# EasyEDA Pro project BlueberryPi.eprj, board PCB1 (continued)
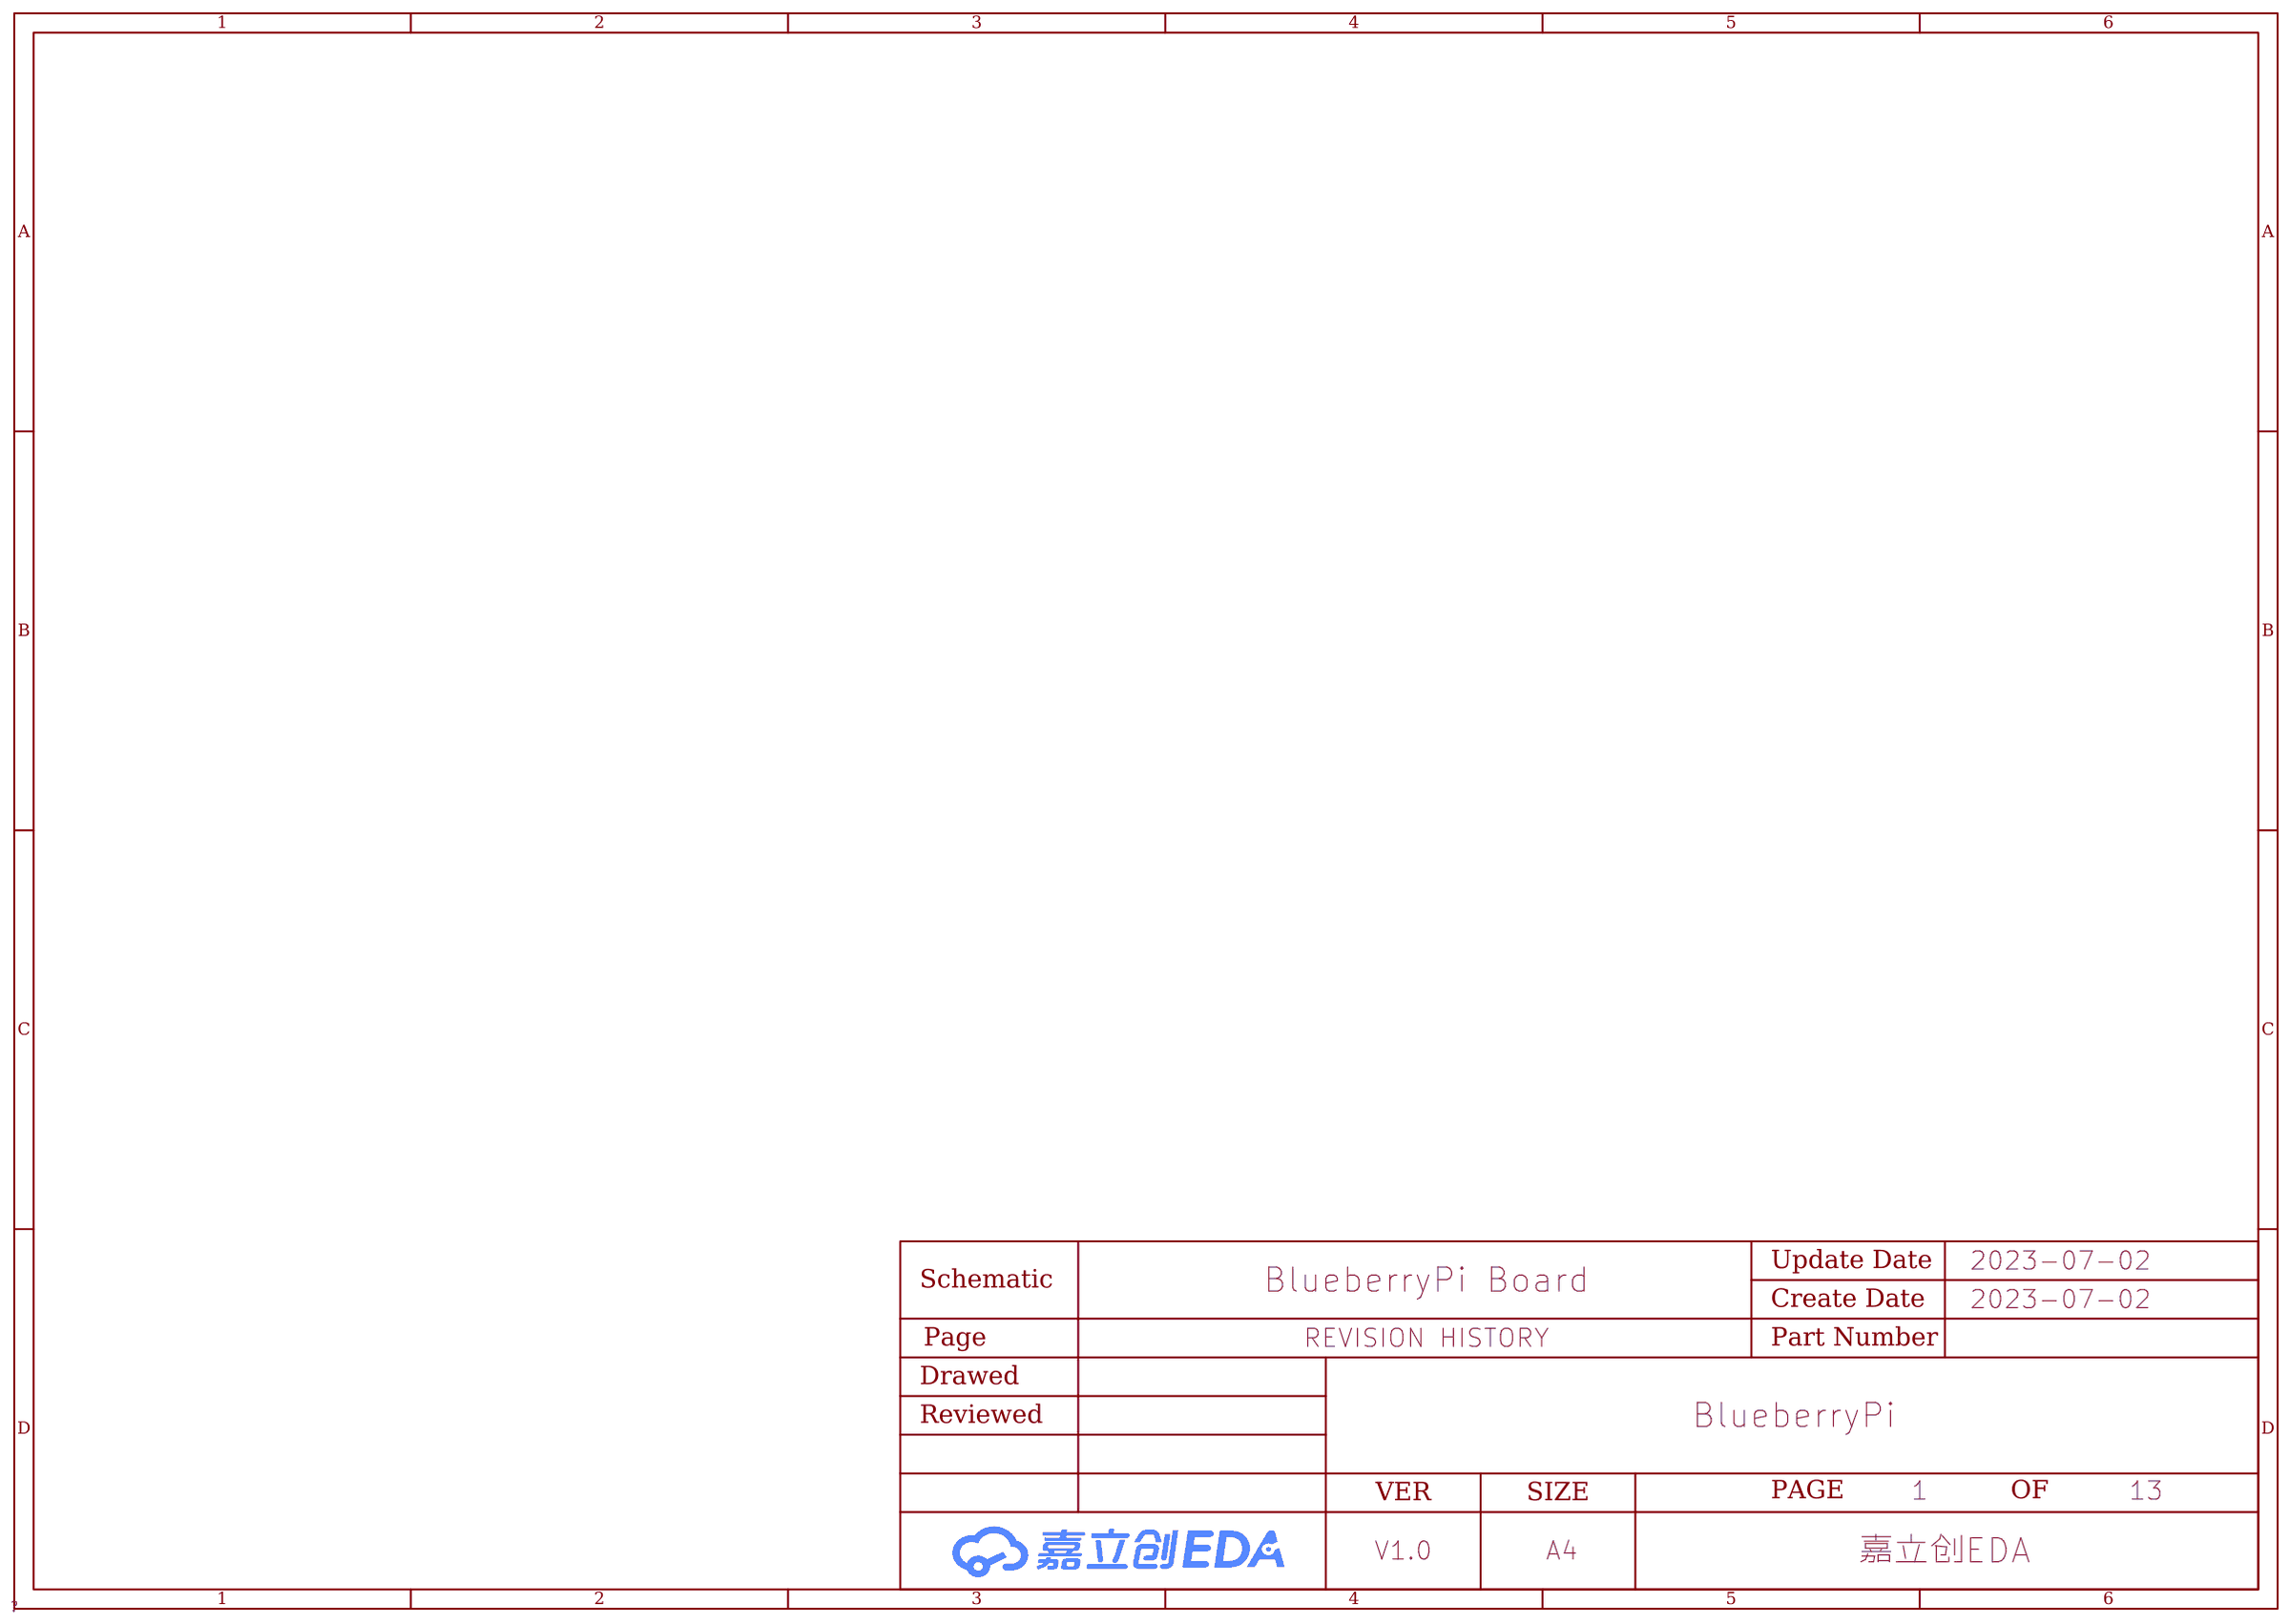
[diagram p0: REVISION HISTORY]
## Footprints (pads in the part's own frame, mm; a bottom-side part is the same pattern mirrored in y, then rotated) (continued)
USB-A-TH_XUNPU_USB-303WSD-BRY
  round 1.1 hole 0.7: 1(-3.5,-1.35) 2(-1,-1.35) 3(1,-1.35) 4(3.5,-1.35) 5(4,0.15) 6(2,0.15) 7(0,0.15) 8(-2,0.15) 9(-4,0.15) 10(-3.5,1.85) 11(-1,1.85) 12(1,1.85) 13(3.5,1.85) 14(4,3.35) 15(2,3.35) 16(0,3.35) 17(-2,3.35) 18(-4,3.35)
  round 3.2 hole 2.4: 19(6.57,-3.35) 20(6.57,2.33) 21(-6.57,2.33) 22(-6.57,-3.35)

## Nets
As in the schematic.

Pads without a net: CN1 14; U1 A3 A5 A6 A8 A9 A10 AA3 AA10 B1 B2 B5 B6 B7 B8 B9 B10 C1 C2 C5 C23 D15 D16 E17 E21 E22 F5 F11 G10 H17 H19 H20 J19 L2 L6 M2 M3 M4 M5 M6 N2 N3 P1 P2 P3 P5 P6 P21 P22 R21 T1 T2 T20 U4 V2 V3 V21 V22 V23 W4 W11 Y21; U35 A1 A2 A12 A13 B1 B4 B13 C4 K9 R3 T1 T13 U1 U2 U12 U13; U37 5 14 21 22 55 56; U39 A1 A2 A7 A8 A9 A10 A11 A12 A13 A14 B1 B7 B8 B9 B10 B11 B12 B13 B14 C1 C3 C5 C7 C8 C9 C10 C11 C12 C13 C14 D1 D2 D3 D4 D12 D13 D14 E1 E2 E3 E5 E8 E9 E10 E12 E13 E14 F1 F2 F3 F10 F12 F13 F14 G1 G2 G3 G10 G12 G13 G14 H1 H2 H3 H12 H13 H14 J1 J2 J3 J12 J13 J14 K1 K2 K3 K6 K7 K10 K12 K13 K14 L1 L2 L3 L12 L13 L14 M1 M2 M3 M7 M8 M9 M10 M11 M12 M13 M14 N1 N3 N6 N7 N8 N9 N10 N11 N12 N13 N14 P1 P2 P7 P8 P9 P10 P11 P12 P13 P14; U64 4 5 8 29 30 32 35 37 38 39 40 45 46 47; U66 4; USB1 2 3 4; USB3 5 6 8 9

## Via types
v1: diameter 5.08, hole 4.064, Top Layer to Bottom Layer, 4 vias
v2: diameter 0.399, hole 0.299, Top Layer to Bottom Layer, 809 vias
v3: diameter 0.4, hole 0.3, Top Layer to Bottom Layer, 21 vias

## Routing (per net, layer and track width the routed paths; a pad name or vN(x,y) marks a point on that pad's centre or on a via; arc(x,y) is an arc through that point)
GND: length 429
  Top Layer w0.127: U1.W1 42.71,45.31 43.35,45.31 U1.W3 ; v2(69.87,49.28) 69.59,49 69.59,48.5 U39.C4 ; U1.E1 42.01,54.08 v2(41.85,54.24) ; 45.61,43.45 45.34,43.18 45.34,42.87 44.98,42.52 U1.AC5 ; U39.N5 73.87,48.39 74.26,48.78 v2(74.37,48.78) ; v2(23.29,22.5) 22.71,23.09 R75.1 ; 55.61,58.14 55.3,57.82 55.3,56.76 U1.A21 ; 45.61,44.33 45.61,44.33 ; U1.AC11 48.88,41.23 v2(49,41.11)
  Top Layer w0.152: U35.T12 54.08,32.18 54.41,32.51 54.41,32.97 v2(54.15,33.22)
  Top Layer w0.203: U37.8 14.68,54.28 ; U37.54 12.68,55.2 U37.57 ; U37.11 15.88,54.28
  Top Layer w0.254: v2(53.77,42.67) 53.79,42.67 U1.AC19 ; v2(51.48,26.34) U35.M4 U35.N4 ; v2(51.48,26.34) v2(51.48,27.14) ; v2(51.48,26.34) v2(52.13,26.34) ; U1.M1 41.9,49.05 v2(38.93,49.05) ; U1.AB21 v2(55.38,43.68) U1.AA20 ; 47.18,32.77 47.92,33.5 47.97,33.5 ; 47.18,32.77 v2(47.18,33.02) ; 47.18,32.77 47,32.59 46.93,32.59 ; 47.18,32.77 v2(47.18,32.58) 47.18,32.34 ; U35.H2 48.88,23.2 v2(48.35,22.67) ; v2(50.18,54.08) U1.C13 ; v2(54.08,26.34) v2(53.43,26.34) ; v2(54.08,26.34) v2(54.08,25.54) ; v2(54.08,26.34) v2(54.08,27.14) U35.R6 v2(53.43,26.34) ; v2(53.43,26.34) v2(53.43,25.54) v2(54.08,25.54) ; v2(43.68,59.08) v2(43.09,59.08) v2(42.46,59.08) v2(41.84,59.08) C49.1 ; v2(51.48,27.14) U35.L6 ; v2(51.48,27.14) v2(52.13,27.14) v2(52.13,26.34) ; v2(46.93,26.34) v2(46.93,25.54) ; v2(46.93,26.34) v2(46.93,27.14) v2(47.58,27.14) ; v2(46.93,26.34) U35.F5 ; v2(46.93,25.54) 46.93,25.39 U35.D3 U35.C3 44.98,24.09 U35.B2 ; v2(46.93,25.54) U35.F4 ; v2(63.5,52.89) 64.29,53.68 64.29,62.73 X2.2 X2.3 60.99,63.35 C40.2 58.65,63.17 56.62,61.14 v2(56.62,59.66) ; v2(54.08,25.54) U35.T3 U35.T2 ; U35.G3 v2(48.23,25.54) U35.F4 ; U1.A23 56.88,56.68 v2(57.1,56.9) ; 47.18,32.34 46.93,32.59 ; 47.18,32.34 U35.F12 ; v2(47.58,27.14) U35.F5 ; v2(47.58,27.14) v2(48.23,27.14) ; U35.F5 U35.F4 ; U1.U23 57.28,46.28 v2(57.3,46.25) ; 46.93,32.59 U35.D12 ; v2(57.51,52.51) 57.12,52.13 U1.H23 ; v2(50.83,29.54) 50.18,30.19 U35.K10 ; U35.M12 52.13,32.59 v2(52.13,32.59) ; v2(14.92,11.96) 15.4,11.49 U66.2 ; v2(60.11,43.98) 59.11,44.98 U1.W23 ; v2(44.98,32.28) 44.98,32.28 U35.B12 ; v2(50.18,43.03) U1.AA14 U1.Y13 49.53,43.68 U1.AA11 ; U1.M23 57.3,49.53 v2(57.46,49.38) ; U1.E18 53,54.51 53,54.95 U1.C18 ; U1.Y5 U1.AA4 U1.AB3 ; 45.61,43.45 45.61,44.33 ; U1.H1 39.24,52.13 C29.1 v2(38.67,52.78) ; 47.97,33.5 47.97,34.34 ; 47.97,33.5 v2(48.98,32.49) U35.J12 ; U35.H10 48.23,29.69 v2(48.23,29.54) ; v2(52.78,44.33) U1.AA16 ; v2(52.13,26.34) U35.N4 ; U35.N4 52.13,25.39 U35.P3 ; v2(41.85,57.07) 42.23,56.68 U1.A1 ; v2(45.63,46.28) v2(44.98,45.63) v2(44.33,45.63) U1.W3 ; v2(52.13,32.59) 52.13,35 C80.1 ; v2(52.13,32.59) U35.P12 ; v2(75.46,47.78) 74.37,47.78 U39.P4 ; U1.C22 U1.D23 57.19,54.73 v2(57.33,54.86) ; U35.K2 v2(50.18,22.67) ; U1.K17 U1.L18 ; U1.A16 52.13,57.26 ; 5.67,30.86 6.37,30.86 6.95,30.28 v2(7.88,30.28) ; U1.AA8 U1.Y7 ; U1.P7 v2(46.93,47.58) ; v2(44.98,27.14) v2(44.98,26.34) v2(45.63,26.34) v2(45.63,27.14) v2(44.98,27.14)
  Top Layer w0.305: U1.H15 U1.H16 U1.J16 ; U1.H15 U1.G15 U1.F15 ; U1.H15 U1.J15 ; v2(48.88,46.93) v2(49.53,46.93) ; v2(48.88,46.93) v2(48.88,46.28) ; v2(48.88,46.93) v2(48.23,46.93) ; v2(48.88,46.93) v2(48.88,47.58) ; v2(49.53,46.93) U1.U12 v2(48.88,46.28) ; v2(49.53,46.93) U1.T13 ; v2(49.53,46.93) v2(49.53,47.58) ; U1.V19 U1.W19 ; U1.V19 v2(53.85,45.86) v2(53.43,46.28) ; U1.V19 U1.V17 ; U1.V19 U1.V20 54.73,45 ; U1.W19 U1.W21 ; U1.W19 U1.W17 ; U1.W19 U1.Y19 v2(52.78,44.33) U1.W17 ; v2(53.43,48.88) v2(53.43,49.53) U1.L18 ; v2(46.93,46.93) v2(46.28,46.93) v2(46.28,46.28) ; v2(46.93,46.93) v2(46.93,47.58) v2(47.58,47.58) ; v2(46.93,46.93) v2(47.58,46.93) ; U1.F15 U1.F14 U1.F13 ; U1.F15 U1.E15 U1.E16 U1.F16 ; U1.F15 U1.F16 ; v2(48.23,50.83) v2(48.88,50.83) ; v2(48.23,50.83) v2(48.23,50.18) ; v2(48.23,50.83) v2(48.23,51.48) ; v2(48.23,50.83) v2(47.58,50.83) ; v2(48.88,50.83) v2(48.88,50.18) ; v2(48.88,50.83) v2(49.53,50.83) ; v2(48.88,50.83) v2(48.88,51.48) ; v2(50.83,50.18) v2(50.83,49.53) ; v2(50.83,50.18) v2(50.18,50.18) ; v2(50.83,50.18) U1.L15 ; v2(50.83,50.18) U1.K14 ; v2(50.83,49.53) v2(50.83,48.88) ; v2(50.83,49.53) U1.M15 ; v2(50.83,49.53) v2(50.18,49.53) ; v2(50.83,47.58) v2(51.48,47.58) v2(51.48,46.93) ; v2(50.83,47.58) v2(50.83,48.23) ; v2(50.83,47.58) v2(50.18,47.58) ; v2(50.83,47.58) U1.T14 ; v2(85.85,28.98) 85.85,26.67 ; v2(49.53,50.83) v2(49.53,50.18) ; v2(49.53,50.83) U1.J12 ; v2(49.53,50.83) U1.K13 ; v2(49.53,50.18) v2(48.88,50.18) ; v2(49.53,50.18) v2(50.18,50.18) ; v2(49.53,50.18) v2(49.53,49.53) ; v2(46.93,50.83) v2(46.93,51.48) ; v2(46.93,50.83) v2(47.58,50.83) ; v2(46.93,50.83) U1.K7 ; v2(46.93,51.48) U1.H8 ; v2(46.93,51.48) v2(47.58,51.48) ; v2(46.93,51.48) U1.J7 ; U1.J16 U1.J15 ; U1.J16 U1.J17 U1.K17 U1.K16 ; U1.J16 U1.K16 ; v2(47.58,50.83) v2(47.58,51.48) ; v2(47.58,50.83) v2(47.58,50.18) v2(48.23,50.18) ; v2(48.88,46.28) v2(48.23,46.28) ; v2(48.88,48.88) v2(48.23,48.88) ; v2(48.88,48.88) v2(48.88,49.53) ; v2(48.88,48.88) v2(48.88,48.23) ; v2(48.88,48.88) v2(49.53,48.88) ; v2(48.23,48.88) v2(48.23,49.53) ; v2(48.23,48.88) v2(48.23,48.23) ; v2(48.88,49.53) v2(48.23,49.53) ; v2(48.88,49.53) v2(49.53,49.53) ; v2(48.88,49.53) v2(48.88,50.18) ; v2(48.23,49.53) v2(48.23,50.18) ; v2(50.18,50.18) v2(50.18,49.53) ; v2(50.18,50.18) U1.K13 ; v2(50.18,49.53) v2(49.53,49.53) ; v2(50.18,49.53) v2(50.18,48.88) ; v2(85.85,20.09) 85.85,17.78 ; U1.W16 U1.W17 ; U1.W17 U1.V17 ; v2(48.23,50.18) v2(48.88,50.18) ; U1.H8 v2(46.28,52.13) ; U1.H8 v2(47.58,52.13) ; v2(52.78,46.28) v2(52.13,46.93) v2(51.48,46.93) ; v2(52.78,46.28) v2(53.43,46.28) ; v2(52.78,46.28) U1.V17 ; v2(49.53,49.53) v2(49.53,48.88) ; v2(47.58,47.58) v2(48.23,47.58) ; v2(47.58,47.58) v2(47.58,46.93) ; v2(48.23,47.58) v2(48.23,46.93) ; v2(48.23,47.58) v2(48.23,48.23) ; v2(48.23,47.58) v2(48.88,47.58) ; v2(75.69,28.98) 75.69,26.67 ; U1.U22 U1.U23 ; v2(48.5,81.09) v2(48.5,79.84) v2(48.5,78.47) v2(48.5,77.15) v2(48.5,75.73) v2(48.5,74.43) v2(48.5,73.12) v2(48.5,71.8) v2(48.5,66.53) v2(48.5,65.16) v2(48.5,63.76) 48.5,59.7 ; U1.T14 v2(51.48,46.93) ; U1.T14 U1.T13 ; v2(51.48,46.93) U1.U15 ; U1.J7 U1.K7 ; U1.J7 v2(46.28,52.13) ; U1.K7 U1.L7 U1.M7 U1.N7 U1.P7 46.28,48.16 ; v2(49.53,48.23) v2(50.18,48.23) ; v2(49.53,48.23) v2(48.88,48.23) ; v2(49.53,48.23) v2(49.53,47.58) ; v2(49.53,48.23) v2(49.53,48.88) ; v2(50.18,48.23) v2(50.18,47.58) ; v2(50.18,48.23) v2(50.83,48.23) ; v2(50.18,48.23) v2(50.18,48.88) ; v2(53.43,46.28) v2(53.43,46.93) ; v2(47.58,51.48) v2(47.58,52.13) ; v2(47.58,51.48) v2(48.23,51.48) ; U1.J15 U1.K15 ; v3(17.72,84) U44.1 v3(15.52,84) ; v2(50.83,48.88) v2(50.18,48.88) ; v2(50.83,48.88) v2(50.83,48.23) ; v2(50.83,48.88) U1.N15 U1.M15 ; U1.K13 U1.K14 ; v2(48.23,46.93) v2(47.58,46.93) ; v2(48.23,46.93) v2(48.23,46.28) ; U1.J12 v2(48.88,51.48) ; U1.J12 U1.H12 ; U1.M15 U1.L15 ; U1.T13 v2(50.18,47.58) ; v2(50.83,55.38) U1.C13 U1.C12 ; v2(47.58,46.93) v2(47.58,46.28) v2(48.23,46.28) ; v2(46.28,52.13) U1.G7 ; v2(48.88,48.23) v2(48.88,47.58) ; v2(48.88,48.23) v2(48.23,48.23) ; U1.K14 U1.K15 ; v2(49.84,63.75) v2(49.84,65.15) v2(49.84,66.51) v2(49.84,67.8) v2(49.84,71.81) v2(49.84,73.11) v2(49.84,74.45) v2(49.84,75.74) v2(49.84,77.15) v2(49.84,78.47) v2(49.84,79.84) D2.3 D2.8 ; U1.AC1 42.25,42.25 v2(42.25,41.95) ; v2(51.26,63.78) v2(51.26,65.15) v2(51.26,66.51) v2(51.26,67.8) v2(51.26,69.06) v2(51.26,73.11) v2(51.26,74.45) v2(51.26,75.72) v2(51.26,77.15) v2(51.26,78.47) v2(51.26,79.84) v2(51.26,81.32) ; U1.F13 U1.F12 ; U1.F13 v2(50.18,54.08) ; v2(50.18,48.88) v2(49.53,48.88) ; U1.W5 U1.Y5 U1.Y7 U1.W7 ; U1.W5 U1.W7 ; U1.W5 v2(44.98,45.63) ; U1.L15 U1.K15 ; v2(47.58,52.13) U1.H10 v2(48.23,51.48) ; v2(47.58,52.13) v2(47.58,52.78) ; v2(48.88,47.58) v2(49.53,47.58) ; v2(49.53,47.58) v2(50.18,47.58) ; U1.W7 U1.V7 v2(46.28,46.28) ; U1.W7 U1.W8 U1.W10 ; U1.R17 U1.R18 v2(53.43,46.93) ; v2(17.11,19.51) 16.26,18.66 v2(16.26,17.93) 16.26,15.55 16.7,15.1 20.4,15.1 20.79,15.49 v2(20.79,16.74) v2(20.79,19.51) ; v2(54.43,63.55) v2(56.72,65.84) v2(59.2,68.32) v2(62.54,71.66) v2(63.83,72.95) v2(65.1,74.22) v2(66.43,75.55) 68.25,77.37 v2(68.25,80.99) v2(68.25,82.79) v2(68.25,84.67) v2(68.25,86.64) v2(68.25,87.5) ; v2(48.23,51.48) v2(48.88,51.48) ; v2(53.43,46.93) U1.T19 ; v2(75.69,20.09) 75.69,17.78 ; U1.K15 U1.K16 ; v2(53.67,65.04) v2(55.64,67.01) v2(58.04,69.41) v2(61.35,72.71) v2(62.67,74.04) v2(63.91,75.28) v2(65.28,76.64) 66.75,78.12 v2(66.75,80.99) v2(66.75,82.79) v2(66.75,84.68) v2(66.75,86.64) v2(66.75,87.5) ; U1.F16 U1.F17 U1.E18 ; v2(69.75,87.5) v2(69.75,86.64) v2(69.75,84.67) v2(69.75,82.79) v2(69.75,81.01) 69.75,76.56 v2(68.94,75.75) v2(67.6,74.41) v2(66.29,73.1) v2(65,71.81) v2(60.38,67.19) v2(57.88,64.69) v2(56.68,63.49) 55.28,62.09 ; v2(45.63,46.28) v2(46.28,46.28)
  Top Layer w0.381: D2.8 49.84,85.6
  Bottom Layer w0.254: v2(71.87,49.3) 71.89,49.3 v2(72.37,49.78) ; C58.1 56.69,46.86 v2(57.3,46.25) ; C81.1 46.93,27.54 v2(46.93,27.14) ; 51.89,27.43 52.13,27.19 v2(52.13,27.14) ; v2(71.37,50.78) 71.01,50.42 v2(71.01,50.3) ; C53.1 56.27,57.19 56.27,58.17 v2(55.73,58.71) ; v2(57.46,49.38) 57.46,49.11 C1.1 ; C14.1 52.12,51.83 C3.1 ; 57.34,53.12 C46.1 ; 57.34,53.12 57.34,52.68 v2(57.51,52.51) ; 57.34,53.12 56.49,53.12 ; C55.1 52.12,54.11 C56.1 ; v2(67.83,44.22) v2(68.87,44.22)
  vias: v2(2.31,15.8) v2(2.46,18.57) v2(2.72,60.69) v2(2.72,54.73) v2(3.77,82.4) v2(3.77,76.1) v2(3.89,18.97) v2(3.89,15.62) v2(4.52,18.2) v2(4.52,16.33) v2(5.41,18.2) v2(5.41,16.33) v2(6.3,18.2) v2(6.3,16.33) v2(6.98,48.5) v2(7.19,18.2) v2(7.19,16.33) v2(7.86,97.05) v2(8.12,18.67) v2(8.05,16.65) v2(8.54,87.34) v2(8.77,75.89) v2(8.93,77.5) v2(8.89,48.53) v2(8.92,19.48) v2(8.88,17.18) v2(9.2,79.38) v2(9.27,33.47) v2(9.27,21.69) v2(9.28,20.46) v2(9.68,17.83) v2(10.38,18.66) v2(10.85,81.69) v2(10.8,48.53) v2(10.82,19.51) v2(11.07,57.39) v2(11.07,21.69) v2(11.08,20.46) v2(11.55,67.21) v2(12.08,60.4) v2(12.14,58.6) v2(12.14,55.8) v2(12.31,54.51) v2(13.58,45.97) v2(13.68,60.4) v2(13.7,54.53) v2(13.77,18.16) v2(14.55,64.23) v2(14.92,6.58) v2(15.2,5.05) v2(15.27,59.54) v2(15.37,17.92) v2(16.28,16.73) v2(16.28,15.26) v2(16.36,64.2) v2(16.66,59.53) v2(16.93,54.55) v2(17.09,57.15) v2(17.09,55.75) v2(17.44,17.92) v2(18.82,86.49) v2(19.64,16.22) v2(19.71,63.99) v2(19.71,36.54) v2(19.66,30.28) v2(20.16,46) v2(20.84,15.25) v2(21.15,5.41) v2(21.56,35.05) v2(22.31,52.04) v2(22.44,60.07) v2(22.44,57.12) v2(22.44,55.37) v2(22.44,53.54) v2(22.53,2.86) v2(22.77,13.31) v2(23.08,11.71) v2(23.22,87.34) v2(23.38,97.05) v2(24.08,2.93) v2(28.97,85.7) v2(29.27,87.27) v2(31.85,87.3) v2(32.91,49.17) v2(34.04,60.56) v2(34.39,52.09) v2(34.39,49.18) v2(34.65,87.3) v2(35.56,60.25) v2(35.88,52.25) v2(36.83,37.25) v2(37.3,29.91) v2(38.48,37.25) v2(39.04,30.06) v2(39.31,64.57) v2(39.47,78.18) v2(39.59,42.39) v2(39.75,37.1) v2(40.64,61.89) v2(40.69,26.05) v2(41.31,81.33) v2(41.75,22.86) v2(43.68,54.08) v2(44.98,54.08) v2(45.52,82.6) v2(45.47,19.32) v2(46.49,21.69) v2(46.71,19.24) v2(47.9,82.6) v2(49.53,25.54) v2(50.18,45.63) v2(50.34,27.95) v2(50.27,21.69) v2(51.77,82.6) v2(52.88,21.69) v2(52.88,20.47) v2(53.14,19.2) v2(53.47,54.08) v2(54.15,82.6) v2(54.41,45.76) v2(54.73,48.29) v2(55.42,78.61) v2(55.38,53.43) v2(56.68,42.38) v2(57.21,81.25) v2(57.28,22.86) v2(58.2,26.05) v2(58.61,59.82) v2(58.59,52.53) v2(59.72,52.42) v2(60.81,58.12) v2(61.29,56.33) v2(66,90.29) v2(66.53,51.3) v2(67.5,90.29) v2(67.87,48.78) v2(69,90.29) v2(69.37,51.17) v2(70.5,90.29) v2(70.54,44.64) v2(70.87,48.28) v2(71.7,86.72) v2(71.87,48.28) v2(72.87,86.72) v2(73.1,29.68) v2(73.5,90.29) v2(73.87,46.78) v2(74.04,86.72) v2(75.21,86.72) v2(75.69,26.67) v2(75.69,17.78) v2(76.38,86.72) v2(78.13,57.16) v2(78.17,60.97) v2(78.92,86.32) v2(82.96,97.14) v2(85.85,26.67) v2(85.85,17.78) v3(13.32,84) v3(14.42,84) v3(19.92,84) v3(21.02,84) v3(22.12,84)
VCC18-RTC: length 69.5
  Top Layer w0.203: R38.1 21.04,53.54
  Top Layer w0.254: C54.2 61.77,51.59 v2(61.77,53.12) ; R26.1 27.53,52.57 27.53,55.58 27.8,55.84 28.27,55.84 28.85,56.43 v2(28.85,57.24) 28.85,58.01 R41.1
  Top Layer w0.305: R26.1 24.83,51.82 23.95,52.69 21.89,52.69 C95.2 ; R41.1 R37.1
  03SIG w0.254: v2(28.85,57.24) 31.36,59.74 43.92,59.74 45.46,61.29 59.55,61.29 61.77,59.07 v2(61.77,53.12)
  04PWR w0.254: v2(54.73,53.43) 54.73,52.59 55.02,52.3 56.46,52.3 56.96,51.8 60.45,51.8 v2(61.77,53.12)
VCC33-WIFI: length 93.8
  Top Layer w0.305: 16.35,11.94 C151.2 14.52,13.77 14.52,18.47 C139.2 16.46,20.41 U64.9 ; 16.35,11.94 16.55,11.74 C148.2 19.91,11.65 R91.2 19.79,10.47 19.09,9.77 19.09,5.35 20.02,4.42 22.06,4.42 C150.1 23.7,3.95 C149.1 25.17,5.42 L7.1 30.07,5.42 31.5,6.85 v2(31.5,25.16) v2(31.5,25.67) ; 16.35,11.94 U66.1 16.35,9.87 15.88,9.4 14.91,9.4 14.45,9.87 U66.3
  Bottom Layer w0.305: v2(28.28,53.39) 27.1,53.39 22.94,49.23 22.94,40.25 31.5,31.69 v2(31.5,25.67)
VCC-DCXOIO: length 179.8
  Top Layer w0.254: U1.A22 56.03,57.15 56.62,57.73 v2(56.62,58.57) ; v2(28.26,61.72) 29.92,61.72 31.69,59.96 v2(31.69,53.33)
  Top Layer w0.305: v2(21.56,33.65) 21.56,33.54 20.11,32.08 U64.22
  03SIG w0.254: 58.07,50.12 56.23,50.12 55.64,49.53 v2(54.08,49.53) ; 58.07,50.12 58.07,57.12 v2(56.62,58.57) 56.01,59.18 45.48,59.18 43.9,57.61 35.97,57.61 v2(31.69,53.33) ; 58.07,50.12 65.34,50.12 65.74,50.53 v2(65.76,50.53)
  Bottom Layer w0.203: v2(45.63,52.13) 45.14,52.62 41.95,52.62 40.23,50.9 34.11,50.9 v2(31.69,53.33)
  Bottom Layer w0.305: v2(4.8,22.12) v2(4.8,23.37) v2(4.8,25.78) 4.8,30.22 9.97,35.39 10.8,35.39 ; 10.8,35.39 v2(10.8,42.43) 10.8,47.42 13.84,50.47 21.49,50.47 24.64,53.62 24.64,58.1 v2(28.26,61.72) ; 10.8,35.39 11.12,35.06 v2(17.09,35.06) 20.15,35.06 v2(21.56,33.65) 22.58,32.64 v2(22.58,30.1) v2(22.58,28.93) 21.92,28.27 21.92,27.25 v2(22.57,26.59) 22.58,26.59 v2(22.58,25.43) v2(22.58,24.26) 22.58,20.01 18.06,15.48 18.06,6.4 v2(15.42,3.76)
  vias: v2(4.81,24.59)
VCC-DRAM: length 56.5
  Top Layer w0.127: C85.2 49.17,24.44 U35.H3 ; v2(47.58,21.69) R20.2
  Top Layer w0.203: C118.2 17.86,46.9 L5.2 17.86,51.32 17.65,51.53 17.08,51.53 15.48,53.14 U37.10 ; v2(52.13,31.94) 51.8,31.61 51.16,31.61 v2(50.83,31.94)
  Top Layer w0.254: v2(43.79,31.27) 43.92,31.14 U35.A11 ; U35.L2 51.03,23.94 ; 51.03,23.94 U35.M2 ; 51.03,23.94 51.03,21.24 v2(51.79,20.47) ; v2(43.51,29.54) U35.A9 ; U35.G2 v2(47.58,23.94) v2(47.58,21.69) ; v2(55.25,29.54) U35.U9 ; U35.J9 50.18,28.89 v2(50.18,28.74) ; U35.J9 U35.H9 v2(48.88,28.74) ; U35.J9 U35.J10 ; v2(52.13,31.94) 52.52,31.55 53.03,31.55 U35.R12 ; v2(52.78,25.54) v2(52.78,26.34) v2(52.78,27.14) ; U35.J5 U35.H5 ; U35.J5 v2(50.18,26.34) ; U35.J5 U35.J6 ; U35.H5 v2(48.23,26.34) ; U35.H5 U35.H6 U35.J6 ; v2(50.18,26.34) v2(50.18,27.14) U35.J6 ; v2(50.18,26.34) U35.L5 ; U35.C12 45.69,32 45.69,32.61 45.69,32.61 45.69,32.77 v2(45.75,32.82) ; U35.J10 50.18,30.99 U35.K11 U35.K12 50.39,31.94 ; U35.J10 48.88,30.99 U35.H11 v2(48.88,31.94) U35.G12 ; 50.39,31.94 v2(50.83,31.94) ; 50.39,31.94 50.42,31.97 50.42,34.54 51.5,34.54 51.61,34.43 ; v2(54.81,31.24) 54.81,31.22 U35.U11 ; U35.D4 v2(46.28,26.34) v2(46.28,27.14) ; U35.A8 v2(44.08,28.74)
  Top Layer w0.305: v2(52.13,46.28) U1.V15 v2(50.83,46.28) v2(50.18,46.28) v2(49.53,45.63) v2(48.88,45.63) v2(48.23,45.63) v2(47.58,45.63) v2(46.93,46.28)
  Bottom Layer w0.254: v2(52.78,27.14) 52.78,27.23 C84.2 ; C81.2 46.28,27.55 v2(46.28,27.14)
  vias: v2(17.31,43.87) v2(17.31,43.1) v2(17.31,42.34) v2(18.07,43.87) v2(18.07,43.1) v2(18.07,42.34) v2(18.83,43.87) v2(18.83,43.1) v2(18.83,42.34) v2(36.83,35.85) v2(37.3,31.31) v2(38.48,35.85) v2(39.04,31.15) v2(39.75,36.01) v2(42.84,22.86) v2(46.93,31.94) v2(46.93,28.74) v2(49.18,21.69) v2(52.13,28.74) v2(54.73,28.74) v2(56.19,22.86)
